# EasyEDA Pro project hardware.eprj, schematic Schematic7

## Sheets
1 P1: Create Date: 2022-12-21; Page Name: P1; Project Name: hardware; Schematic Name: Schematic7; Update Date: 2022-12-21; Company: 嘉立创EDA; Page Size: A4; Version: V1.0
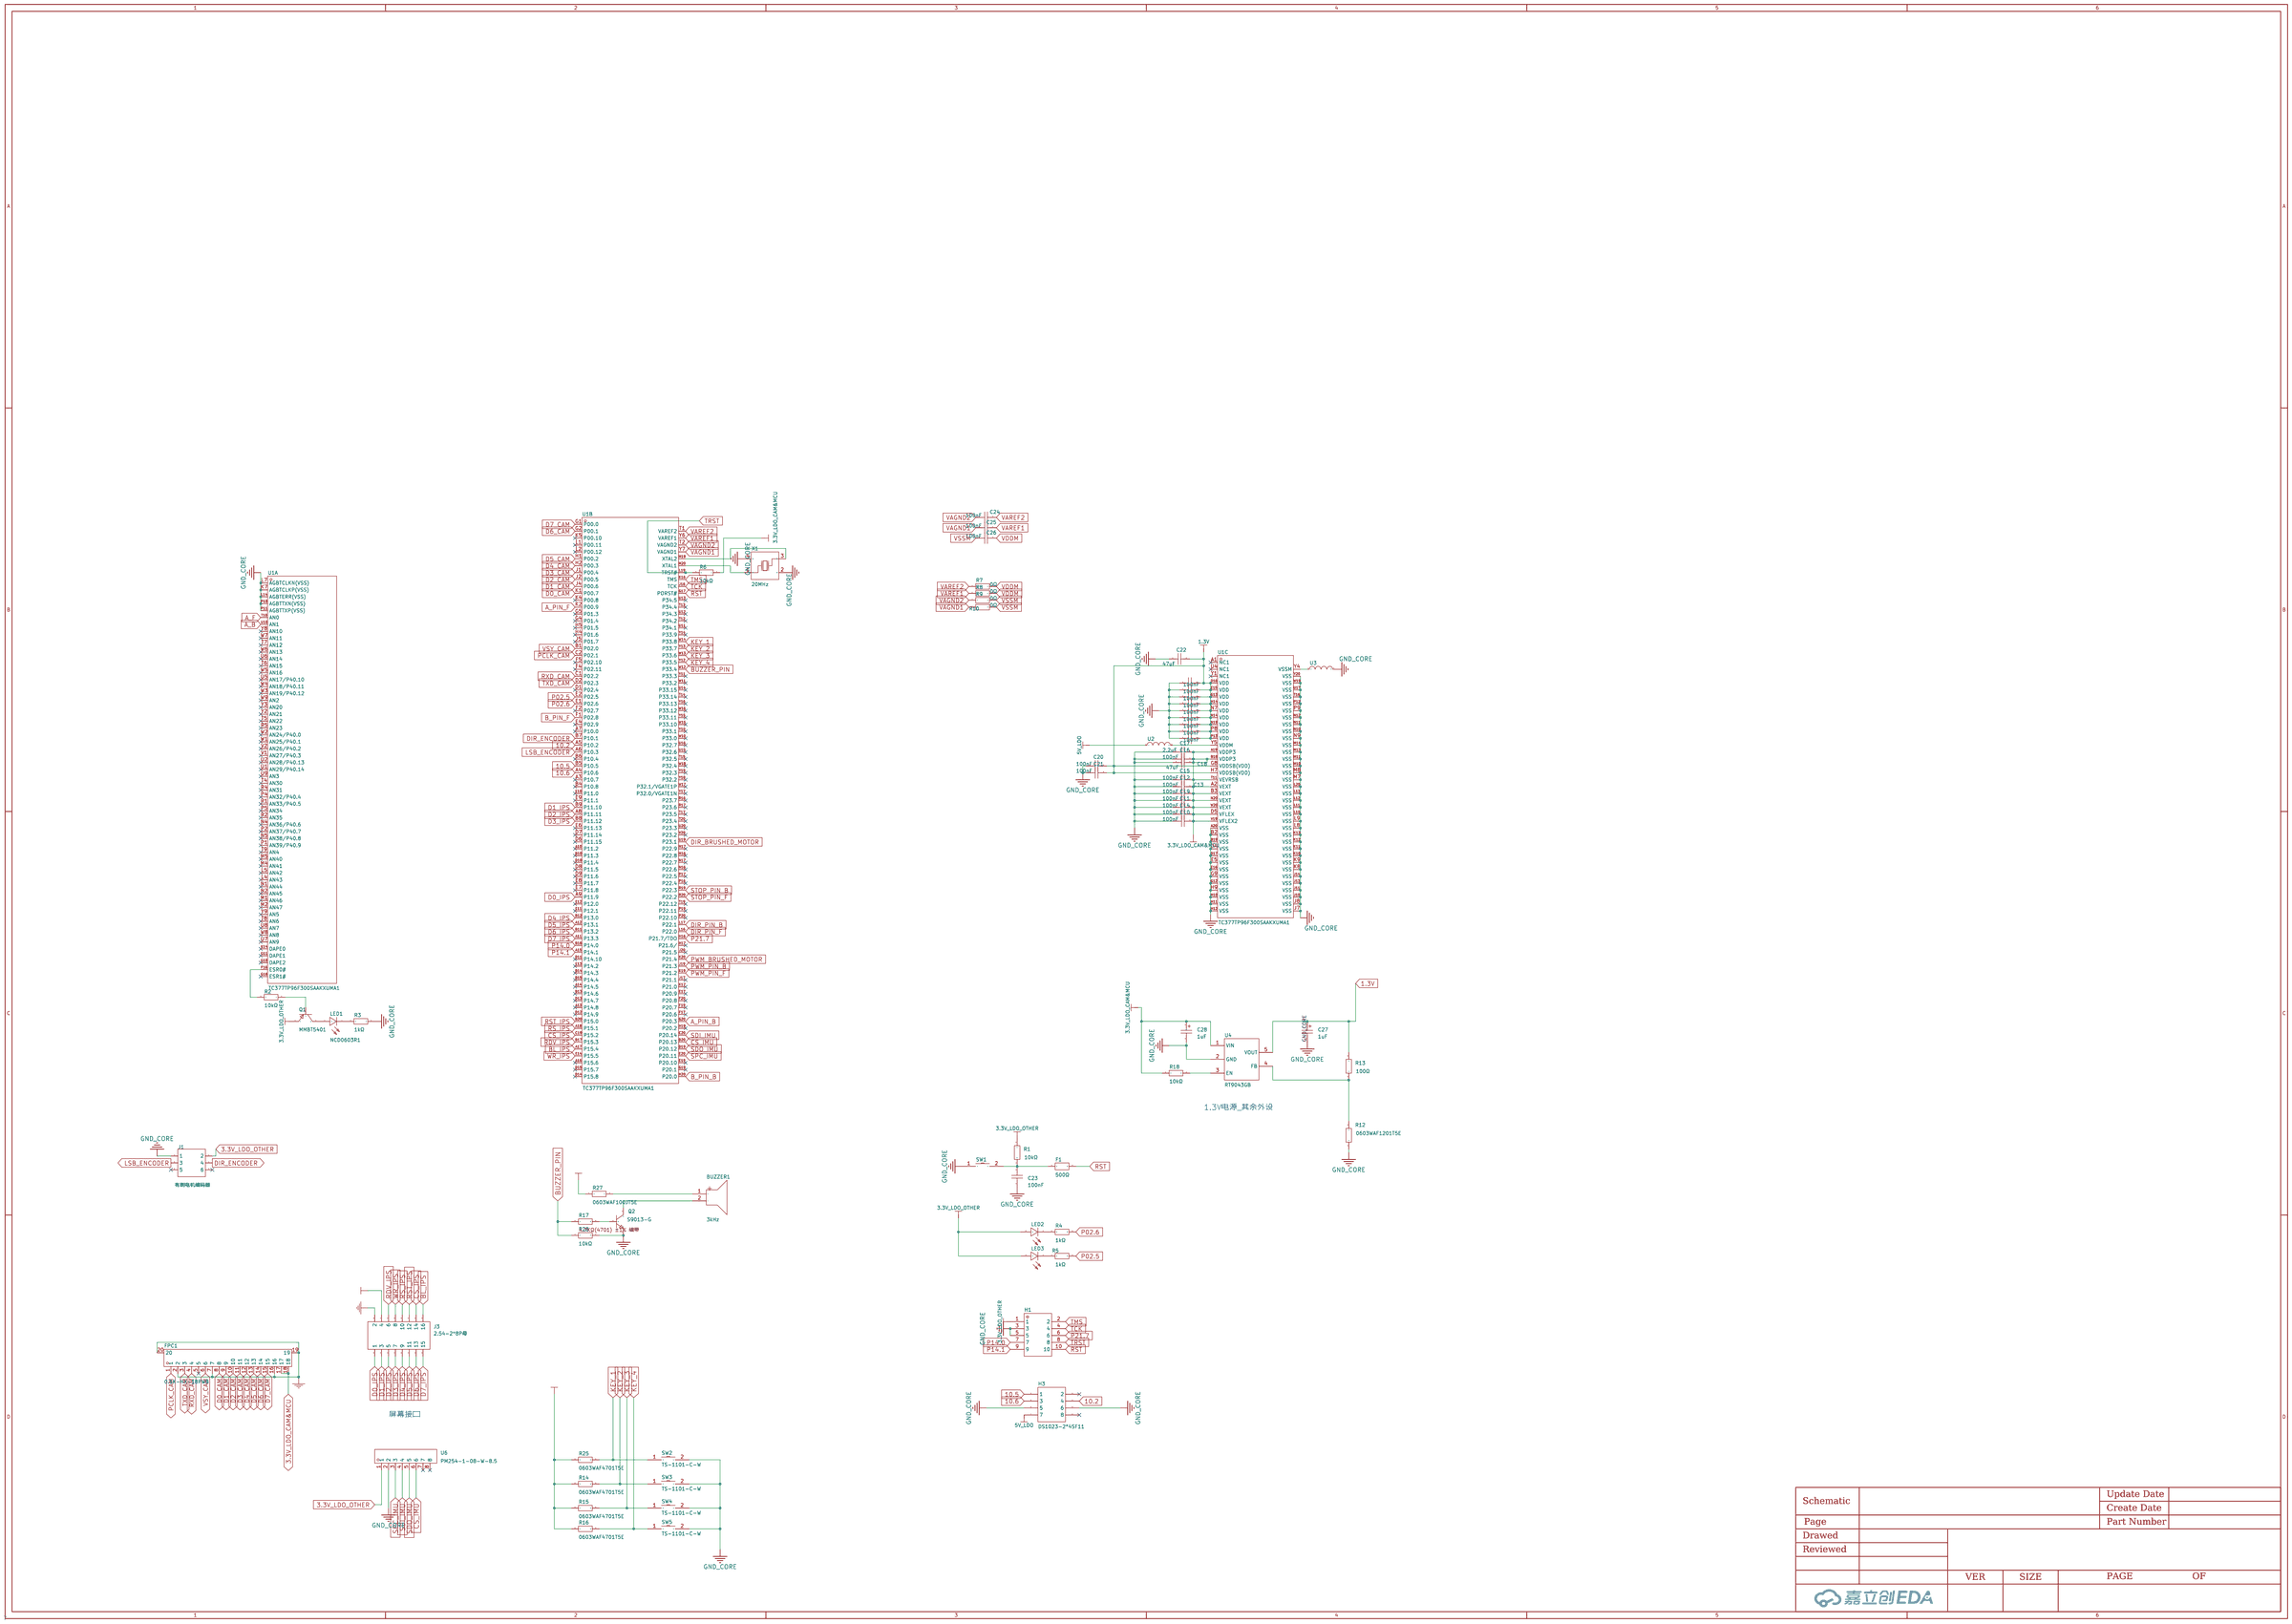
[diagram p8: P1]
2 P2: Page Name: P2
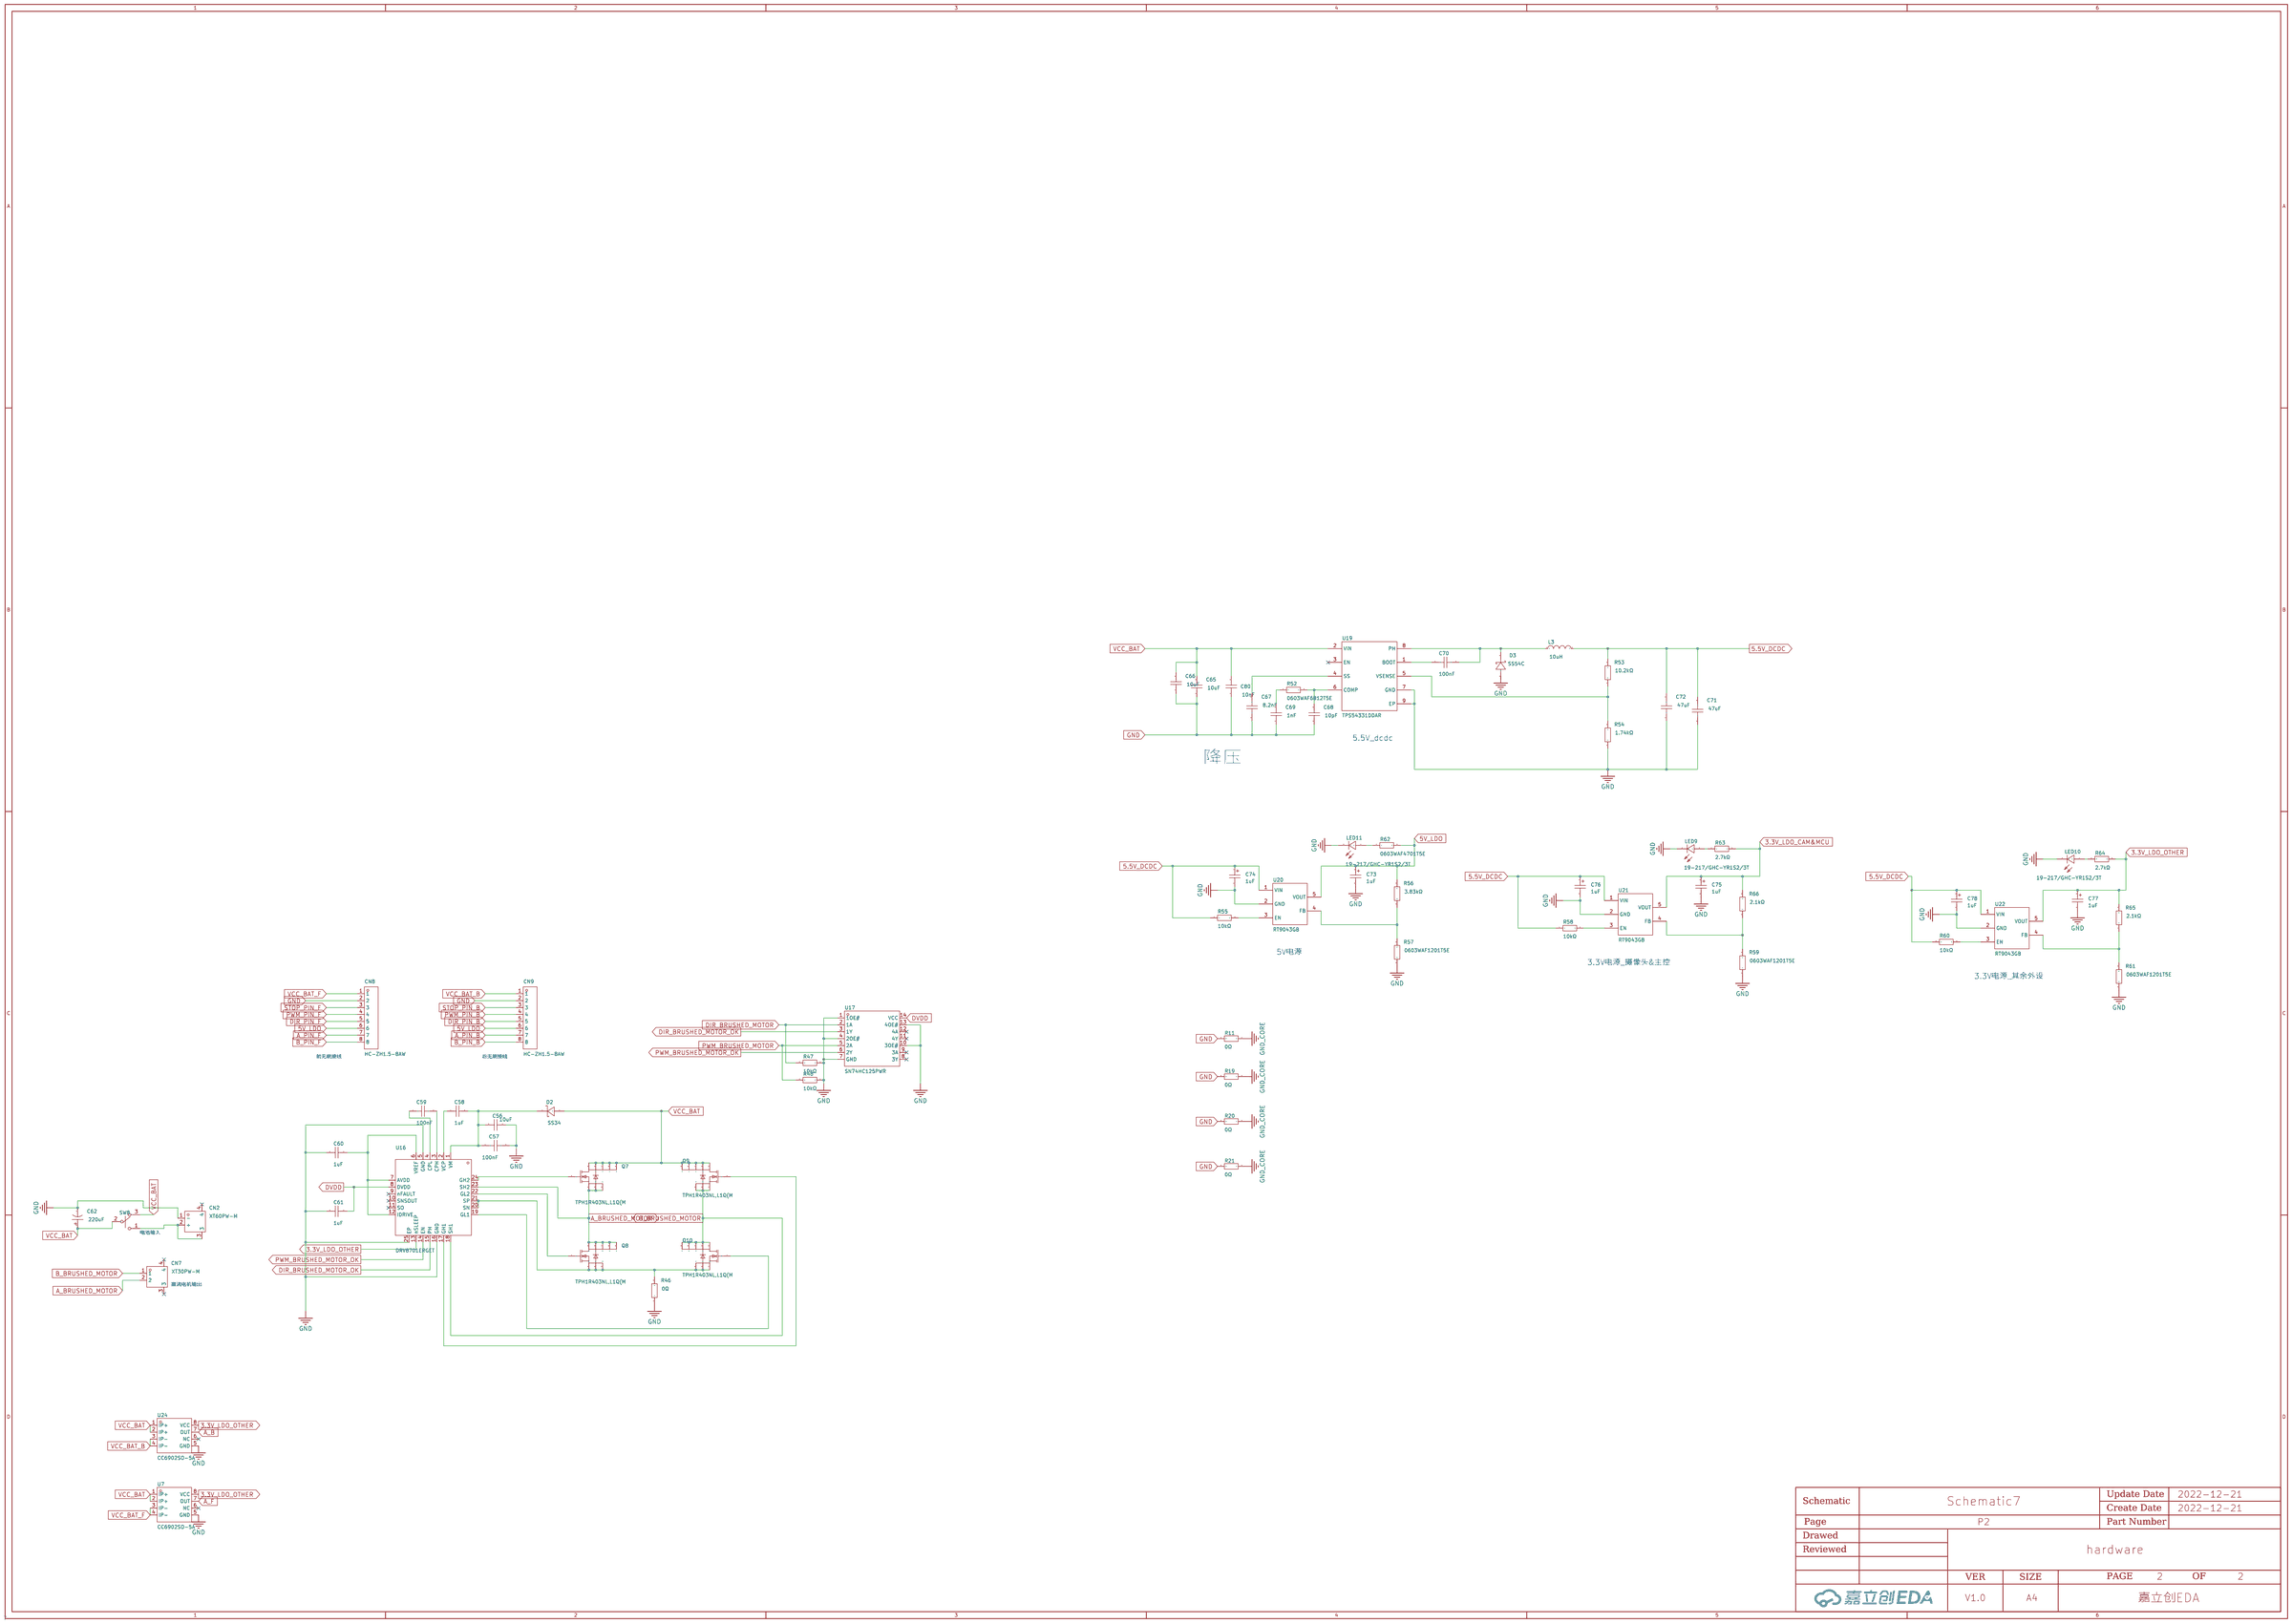
[diagram p9: P2]

## Parts
sheet P1
BUZZER1  3kHz  [BUZ-TH_BD9.0-P5.00-D0.6-FD]
C1  100nF  [C0402_NEW]
C2  100nF  [C0402_NEW]
C3  100nF  [C0402_NEW]
C4  100nF  [C0402_NEW]
C5  100nF  [C0402_NEW]
C6  100nF  [C0402_NEW]
C7  100nF  [C0402_NEW]
C8  100nF  [C0402_NEW]
C10  100nF  [C0402_NEW]
C11  100nF  [C0402_NEW]
C12  100nF  [C0402_NEW]
C13  100nF  [C0402_NEW]
C14  100nF  [C0402_NEW]
C15  100nF  [C0402_NEW]
C16  100nF  [C0402_NEW]
C17  2.2uF  [C0603]
C18  47uF  [C0603]
C19  100nF  [C0402_NEW]
C20  100nF  [C0402_NEW]
C21  100nF  [C0402_NEW]
C22  47uF  [C0603]
C23  100nF  [C0402_NEW]
C24  100nF  [C0402_NEW]
C25  100nF  [C0402_NEW]
C26  100nF  [C0402_NEW]
C27  1uF  [CAP-SMD_L3.2-W1.6-RD]
C28  1uF  [CAP-SMD_L3.2-W1.6-RD]
C81  100nF  [C0402_NEW]
F1  500Ω  [R0603]
FPC1  0.5K-HX-18PWB  [FPC-SMD_18P-P0.50_HDGC_0.5K-HX-18PWB]
H1  B-2100S10P-B110  [HDR-TH_10P-P2.54-V-M-R2-C5-S2.54]
H3  DS1023-2*4SF11  [HDR-TH_8P-P2.54-V-F-R2-C4-S2.54-1]
J1  有刷电机编码器  [HDR-TH_6P-P2.54-V-M-R2-C3-S2.54-1]
J3  2.54-2*8P母  [HDR-TH_16P-P2.54-V-F-R2-C8-S2.54-1]
LED1  NCD0603R1  [LED0603-RD_RED]
LED2  NCD0603R1  [LED0603-RD_RED]
LED3  NCD0603R1  [LED0603-RD_RED]
Q1  MMBT5401  [SOT-23-3_L2.9-W1.3-P1.90-LS2.4-BR]
Q2  S9013-G  [SOT-23-3_L2.9-W1.3-P1.90-LS2.4-BR]
R1  10kΩ  [R0603]
R2  10kΩ  [R0603]
R3  1kΩ  [R0603]
R4  1kΩ  [R0603]
R5  1kΩ  [R0603]
R6  10kΩ  [R0603]
R7  0Ω  [R0603]
R8  0Ω  [R0603]
R9  0Ω  [R0603]
R10  0Ω  [R0603]
R12  0603WAF1201T5E  [R0603]
R13  100Ω  [R0603]
R14  0603WAF4701T5E  [R0603]
R15  0603WAF4701T5E  [R0603]
R16  0603WAF4701T5E  [R0603]
R17  0603WAF4701T5E  [R0603]
R18  10kΩ  [R0603]
R25  0603WAF4701T5E  [R0603]
R27  0603WAF100JT5E  [R0603]
R28  10kΩ  [R0603]
SW1  TS-1101-C-W  [SW-SMD_L6.0-W3.3-LS8.0]
SW2  TS-1101-C-W  [SW-SMD_L6.0-W3.3-LS8.0]
SW3  TS-1101-C-W  [SW-SMD_L6.0-W3.3-LS8.0]
SW4  TS-1101-C-W  [SW-SMD_L6.0-W3.3-LS8.0]
SW5  TS-1101-C-W  [SW-SMD_L6.0-W3.3-LS8.0]
U1  TC377TP96F300SAAKXUMA1  [PG-LFBGA-292_L17.0-W17.0-P0.80-BL_INFINEON_SAK-TC29XXXX]  (sections 1,2,3)
U2  CBM160808U501T  [L0603]
U3  CBM160808U501T  [L0603]
U4  RT9043GB  [SOT-23-5_L3.0-W1.7-P0.95-LS2.8-BR]
U6  PM254-1-08-W-8.5  [HDR-TH_8P-P2.54-H-F-W10.0-N]
X1  20MHz  [OSC-SMD_4P-L3.2-W2.5-BL]
sheet P2
C56  10uF  [C1206]
C57  100nF  [C0603]
C58  1uF  [C0603]
C59  100nF  [C0603]
C60  1uF  [C0603]
C61  1uF  [C0603]
C62  220uF  [CAP-TH_BD10.0-P5.00-D1.0-FD]
C65  10uF  [C1206]
C66  10uF  [C1206]
C67  8.2nF  [C0603]
C68  10pF  [C0402]
C69  1nF  [C0603]
C70  100nF  [C0603]
C71  47uF  [C1206]
C72  47uF  [C1206]
C73  1uF  [CAP-SMD_L3.2-W1.6-RD]
C74  1uF  [CAP-SMD_L3.2-W1.6-RD]
C75  1uF  [CAP-SMD_L3.2-W1.6-RD]
C76  1uF  [CAP-SMD_L3.2-W1.6-RD]
C77  1uF  [CAP-SMD_L3.2-W1.6-RD]
C78  1uF  [CAP-SMD_L3.2-W1.6-RD]
C80  10nF  [C0603]
CN2  XT60PW-M  [CONN-TH_XT60PW-M]
CN7  XT30PW-M  [CONN-TH_XT30PW-M]
CN8  HC-ZH1.5-8AW  [CONN-TH_8P-P1.50_HCTL_HC-ZH1.5-8AW]
CN9  HC-ZH1.5-8AW  [CONN-TH_8P-P1.50_HCTL_HC-ZH1.5-8AW]
D2  SS34  [DO-214AC_L4.3-W2.7-LS5.3-RD]
D3  SS54C  [SMC_L6.9-W5.9-LS7.9-R-RD]
L3  10uH  [IND-SMD_L11.5-W10.0_SMMS1040]
LED9  19-217/GHC-YR1S2/3T  [LED0603-R-RD]
LED10  19-217/GHC-YR1S2/3T  [LED0603-R-RD]
LED11  19-217/GHC-YR1S2/3T  [LED0603-R-RD]
Q7  TPH1R403NL,L1Q(M  [DSOP-8_L5.0-W5.0-P1.27-LS6.0-BL-EP]
Q8  TPH1R403NL,L1Q(M  [DSOP-8_L5.0-W5.0-P1.27-LS6.0-BL-EP]
Q9  TPH1R403NL,L1Q(M  [DSOP-8_L5.0-W5.0-P1.27-LS6.0-BL-EP]
Q10  TPH1R403NL,L1Q(M  [DSOP-8_L5.0-W5.0-P1.27-LS6.0-BL-EP]
R11  0Ω  [R0603]
R19  0Ω  [R0603]
R20  0Ω  [R0603]
R21  0Ω  [R0603]
R46  0Ω  [R0603]
R47  10kΩ  [R0603]
R48  10kΩ  [R0603]
R52  0603WAF6812T5E  [R0603]
R53  10.2kΩ  [R0603]
R54  1.74kΩ  [R0603]
R55  10kΩ  [R0603]
R56  3.83kΩ  [R0603]
R57  0603WAF1201T5E  [R0603]
R58  10kΩ  [R0603]
R59  0603WAF1201T5E  [R0603]
R60  10kΩ  [R0603]
R61  0603WAF1201T5E  [R0603]
R62  0603WAF4701T5E  [R0603]
R63  2.7kΩ  [R0603]
R64  2.7kΩ  [R0603]
R65  2.1kΩ  [R0603]
R66  2.1kΩ  [R0603]
SW8  MT-0-103-A101-M200-RS+PJ  [SW-TH_MT-0-103-A101-M200-RS]
U7  CC6902SO-5A  [SOP-8_L4.9-W3.9-P1.27-LS6.0-BL]
U16  DRV8701ERGET  [VQFN-24_L4.0-W4.0-P0.50-LS4.0-BL-EP]
U17  SN74HC125PWR  [TSSOP-14_L5.0-W4.4-P0.65-LS6.5-BL]
U19  TPS54331DDAR  [SOIC-8_L5.0-W4.0-P1.27-LS6.0-BL-EP2.0]
U20  RT9043GB  [SOT-23-5_L3.0-W1.7-P0.95-LS2.8-BR]
U21  RT9043GB  [SOT-23-5_L3.0-W1.7-P0.95-LS2.8-BR]
U22  RT9043GB  [SOT-23-5_L3.0-W1.7-P0.95-LS2.8-BR]
U24  CC6902SO-5A  [SOP-8_L4.9-W3.9-P1.27-LS6.0-BL]

## Library data of the parts
BUZZER1 = HNB09A03: 驱动方式:电磁式;构造类型:有源;额定电压:3V;工作电压:1.5V~4.5V;消耗电流:30mA;频率:3kHz;声压(SPL):85dB@10cm;直径(φD):9mm;长度:-;宽度:-;高度:5.5mm;工作温度:-20~+70;; LCSC Part Name: 电磁式有源一体蜂鸣器HNB09A03; Supplier Part: C96102; Manufacturer: 华能; Supplier Footprint: 插件,P=5mm; JLCPCB Part Class: Extended Part; Datasheet: https://atta.szlcsc.com/upload/public/pdf/source/20170522/1495448326172.pdf; Supplier: LCSC; Oscillator Circuit: 电磁式; Technology Type: 有源; Rated Voltage: 3V; Operating Voltage: 1.5V~4.5V; Current Consumption: 30mA; Sound Pressure Level (SPL): 85dB@10cm; Diameter (φD): 9mm; Height: 5.5mm; Operating Temperature: -20~+70
C1-C8 C10-C16 C19-C21 C23-C26 C81 = CL05B104KO5NNNC: 容值:100nF;精度:±10%;额定电压:16V;材质(温度系数):X7R;; LCSC Part Name: 100nF ±10% 16V; Supplier Part: C1525; Manufacturer: SAMSUNG(三星); Supplier Footprint: 0402; JLCPCB Part Class: Basic Part; Datasheet: https://atta.szlcsc.com/upload/public/pdf/source/20160103/1457707674891.pdf; Supplier: LCSC; Tolerance: ±10%; Voltage Rated: 16V; Temperature Coefficient: X7R
C17 = CL10A225KO8NNNC: 容值:2.2uF;精度:±10%;额定电压:16V;材质(温度系数):X5R;; LCSC Part Name: 2.2uF ±10% 16V; Supplier Part: C23630; Manufacturer: SAMSUNG(三星); Supplier Footprint: 0603; JLCPCB Part Class: Basic Part; Datasheet: https://atta.szlcsc.com/upload/public/pdf/source/20160103/1457707709512.pdf; Supplier: LCSC; Tolerance: ±10%; Voltage Rated: 16V; Temperature Coefficient: X5R
C18 C22 = GRM188R60J476ME15D: 容值:47uF;精度:±20%;额定电压:6.3V;材质(温度系数):X5R;; LCSC Part Name: 47uF ±20% 6.3V; Supplier Part: C140782; Manufacturer: muRata(村田); Supplier Footprint: 0603; JLCPCB Part Class: Extended Part; Datasheet: https://atta.szlcsc.com/upload/public/pdf/source/20171113/C140782_15105612981581115778.pdf; Supplier: LCSC; Tolerance: ±20%; Voltage Rated: 6.3V; Temperature Coefficient: X5R
C27 C28 C73-C78 = TAJA105K016RNJ: 容值:1uF;精度:±10%;额定电压:16V;等效串联电阻:-;工作温度:-55~+125;; LCSC Part Name: 1uF ±10% 16V; Supplier Part: C7174; Manufacturer: Kyocera AVX; Supplier Footprint: CASE-A_3216; JLCPCB Part Class: Extended Part; Datasheet: https://atta.szlcsc.com/upload/public/pdf/source/20160107/1457707748219.pdf; Supplier: LCSC; Tolerance: ±10%; Rated Voltage: 16V; Operating Temperature: -55~+125
F1 = RT0603BRC07500RL: 电阻类型:薄膜电阻;阻值:500Ω;精度:±0.1%;功率:100mW;温度系数:±15ppm/℃;工作温度范围:-55℃~+155℃;; LCSC Part Name: 500Ω ±0.1% 100mW; Supplier Part: C860931; Manufacturer: YAGEO(国巨); Supplier Footprint: 0603; JLCPCB Part Class: Extended Part; Datasheet: https://atta.szlcsc.comnull; Supplier: LCSC; Type: 薄膜电阻; Tolerance: ±0.1%; Power(Watts): 100mW; Temperature Coefficient: ±15ppm/℃; Operating Temperature Range: -55℃~+155℃
FPC1 = 0.5K-HX-18PWB: 间距:0.5mm;触点数量:18;锁定特性:翻盖式;安装类型:卧贴;触点类型:双侧触点/上下接;工作温度范围:-55℃~+85℃;; LCSC Part Name: 0.5mm P数:18 翻盖式 双侧触点/上下接 前插后掀盖式; Supplier Part: C2919497; Manufacturer: HDGC(华德共创); Supplier Footprint: SMD,P=0.5mm; JLCPCB Part Class: Extended Part; Datasheet: https://atta.szlcsc.com/upload/public/pdf/source/20211115/2CE54BFA88E8212E4957B08411109FCD.pdf; Supplier: LCSC; Pitch: 0.5mm; Number of Contacts: 18; Locking Feature: 翻盖式; Mounting Type: 卧贴; Contact Type: 双侧触点/上下接; Height Above Board: 1mm; FFC, FCB Thickness: 0.3mm; Operating Temperature Range: -55℃~+85℃
H1 = B-2100S10P-B110: 间距:2.54mm;总PIN位数:10;排数:2;插针结构:2x5P;行距:2.54mm;安装类型:直插;圆针/方针:-;额定电流:-;额定电压:-;配合针长度:6mm;塑高:2.54mm;端接针长度:3mm;触头材质:黄铜;触头镀层:-;工作温度范围:-40℃~+105℃;颜色:黑色;; LCSC Part Name: 2.54mm 2x5P 直插; Supplier Part: C124387; Manufacturer: Ckmtw(灿科盟); Supplier Footprint: 直插,P=2.54mm; JLCPCB Part Class: Extended Part; Datasheet: https://atta.szlcsc.com/upload/public/pdf/source/20170821/C124387_1503303312729901541.pdf; Supplier: LCSC; Pitch: 2.54mm; Number of Pins: 10; Number of Rows: 2; Pin Structure: 2x5P; Row Spacing: 2.54mm; Mounting Type: 直插; Length of Mating Pin: 6mm; Insulation Height: 2.54mm; Length of End Connection Pin: 3mm; Contact Material: 黄铜; Operating Temperature Range: -40℃~+105℃; Color: 黑色
H3 = DS1023-2*4SF11: 间距:2.54mm;总孔位数:8;排数:2;插孔结构:2x4P;行距:2.54mm;安装类型:直插;塑高:-;触头材质:-;触头镀层:-;; LCSC Part Name: 2.54mm 2x4P 黑色，镀全金; Supplier Part: C92271; Manufacturer: CONNFLY; Supplier Footprint: 直插,P=2.54mm; JLCPCB Part Class: Extended Part; Datasheet: https://atta.szlcsc.com/upload/public/pdf/source/20170116/1484561257216.pdf; Supplier: LCSC; Pitch: 2.54mm; Number of Holes: 8; Number of Rows: 2; Holes Structure: 2x4P; Row Spacing: 2.54mm; Mounting Type: 直插
J1 = 2.54-2*3P针: 间距:2.54mm;总PIN位数:6;排数:2;插针结构:-;行距:-;安装类型:直插;圆针/方针:-;额定电流:-;额定电压:-;配合针长度:-;塑高:-;触头材质:-;触头镀层:-;颜色:黑色;; LCSC Part Name: 2.54mm 直插; Supplier Part: C65114; Manufacturer: BOOMELE(博穆精密); Supplier Footprint: 直插,P=2.54mm; JLCPCB Part Class: Extended Part; Datasheet: https://atta.szlcsc.comnull; Supplier: LCSC; Pitch: 2.54mm; Number of Pins: 6; Number of Rows: 2; Mounting Type: 直插; Color: 黑色
J3 = 2.54-2*8P母: 间距:2.54mm;总孔位数:16;排数:2;插孔结构:2x8P;行距:2.54mm;安装类型:直插;塑高:-;触头材质:黄铜;触头镀层:-;; LCSC Part Name: 2.54mm 2x8P; Supplier Part: C30734; Manufacturer: BOOMELE(博穆精密); Supplier Footprint: 直插,P=2.54mm; JLCPCB Part Class: Extended Part; Datasheet: https://atta.szlcsc.com/upload/public/pdf/source/20151109/1457707555924.pdf; Supplier: LCSC; Pitch: 2.54mm; Number of Holes: 16; Number of Rows: 2; Holes Structure: 2x8P; Row Spacing: 2.54mm; Mounting Type: 直插; Contact Material: 黄铜
LED1-LED3 = NCD0603R1_C84263: 发光颜色:红灯;; LCSC Part Name: 红灯; Supplier Part: C84263; Manufacturer: 国星光电; Supplier Footprint: 0603; JLCPCB Part Class: Extended Part; Datasheet: https://atta.szlcsc.com/upload/public/pdf/source/20200820/C84263_DABC6A75E58F576973B407FDBA283D60.pdf; Supplier: LCSC; Emitted Color: 红灯
Q1 = MMBT5401_C8326: 晶体管类型:PNP;集射极击穿电压(Vceo):150V;集电极电流(Ic):600mA;功率(Pd):300mW;集电极截止电流(Icbo):100nA;集电极-发射极饱和电压(VCE(sat)@Ic,Ib):500mV@50mA,5mA;直流电流增益(hFE@Ic,Vce):200@10mA,5V;特征频率(fT):100MHz;工作温度:+150℃@(Tj);; LCSC Part Name: PNP 150V 600mA; Supplier Part: C8326; Manufacturer: CJ(江苏长电/长晶); Supplier Footprint: SOT-23-3; JLCPCB Part Class: Basic Part; Datasheet: https://atta.szlcsc.com/upload/public/pdf/source/20140809/1457707213644.pdf; Supplier: LCSC; Transistor Type: PNP; Collector-Emitter Breakdown Voltage (Vceo): 150V; Collector Current (Ic): 600mA; Power Dissipation (Pd): 300mW; Collector Cut-Off Current (Icbo): 100nA; Collector-Emitter Saturation Voltage (VCE(sat)@Ic,Ib): 500mV@50mA,5mA; DC Current Gain (hFE@Ic,Vce): 200@10mA,5V; Transition Frequency (fT): 100MHz; Operating Temperature: +150℃@(Tj)
Q2 = S9013-G: 晶体管类型:NPN;集射极击穿电压(Vceo):25V;集电极电流(Ic):500mA;功率(Pd):300mW;; LCSC Part Name: S9013 H档(200-350) H档(200-350); Supplier Part: C164888; Manufacturer: CJ(江苏长电/长晶); Supplier Footprint: SOT-23(SOT-23-3); JLCPCB Part Class: Extended Part; Datasheet: https://atta.szlcsc.com/upload/public/pdf/source/20171228/C164888_15144412896081213891.pdf; Supplier: LCSC; Transistor Type: NPN; Collector-Emitter Breakdown Voltage (Vceo): 25V; Collector Current (Ic): 500mA; Power Dissipation (Pd): 300mW
R1 R2 R6 = 0603WAF1002T5E: 电阻类型:厚膜电阻;阻值:10kΩ;精度:±1%;功率:100mW;温度系数:±100ppm/℃;最大工作电压:75V;工作温度范围:-55℃~+155℃;; LCSC Part Name: 10kΩ ±1% 100mW; Supplier Part: C25804; Manufacturer: UNI-ROYAL(厚声); Supplier Footprint: 0603; JLCPCB Part Class: Basic Part; Datasheet: https://atta.szlcsc.com/upload/public/pdf/source/20200306/C422600_1E6D84923E4A46A82E41ADD87F860B5C.pdf; Supplier: LCSC; Type: 厚膜电阻; Tolerance: ±1%; Power(Watts): 100mW; Temperature Coefficient: ±100ppm/℃; Overload Voltage (Max): 75V; Operating Temperature Range: -55℃~+155℃
R3-R5 = 0603WAF1001T5E: 电阻类型:厚膜电阻;阻值:1kΩ;精度:±1%;功率:100mW;温度系数:±100ppm/℃;最大工作电压:75V;工作温度范围:-55℃~+155℃;; LCSC Part Name: 1kΩ ±1% 100mW; Supplier Part: C21190; Manufacturer: UNI-ROYAL(厚声); Supplier Footprint: 0603; JLCPCB Part Class: Basic Part; Datasheet: https://atta.szlcsc.com/upload/public/pdf/source/20200306/C422600_1E6D84923E4A46A82E41ADD87F860B5C.pdf; Supplier: LCSC; Type: 厚膜电阻; Tolerance: ±1%; Power(Watts): 100mW; Temperature Coefficient: ±100ppm/℃; Overload Voltage (Max): 75V; Operating Temperature Range: -55℃~+155℃
R7-R10 = 0603WAJ0000T5E: 电阻类型:厚膜电阻;阻值:0Ω;精度:±5%;功率:100mW;温度系数:±800ppm/℃;最大工作电压:75V;工作温度范围:-55℃~+155℃;; LCSC Part Name: 0Ω ±5% 100mW; Supplier Part: C15402; Manufacturer: UNI-ROYAL(厚声); Supplier Footprint: 0603; JLCPCB Part Class: Extended Part; Datasheet: https://atta.szlcsc.com/upload/public/pdf/source/20200306/C422600_1E6D84923E4A46A82E41ADD87F860B5C.pdf; Supplier: LCSC; Type: 厚膜电阻; Tolerance: ±5%; Power(Watts): 100mW; Temperature Coefficient: ±800ppm/℃; Overload Voltage (Max): 75V; Operating Temperature Range: -55℃~+155℃